# EasyEDA Pro project cubicat_pcb.eprj, board PCB_lcd
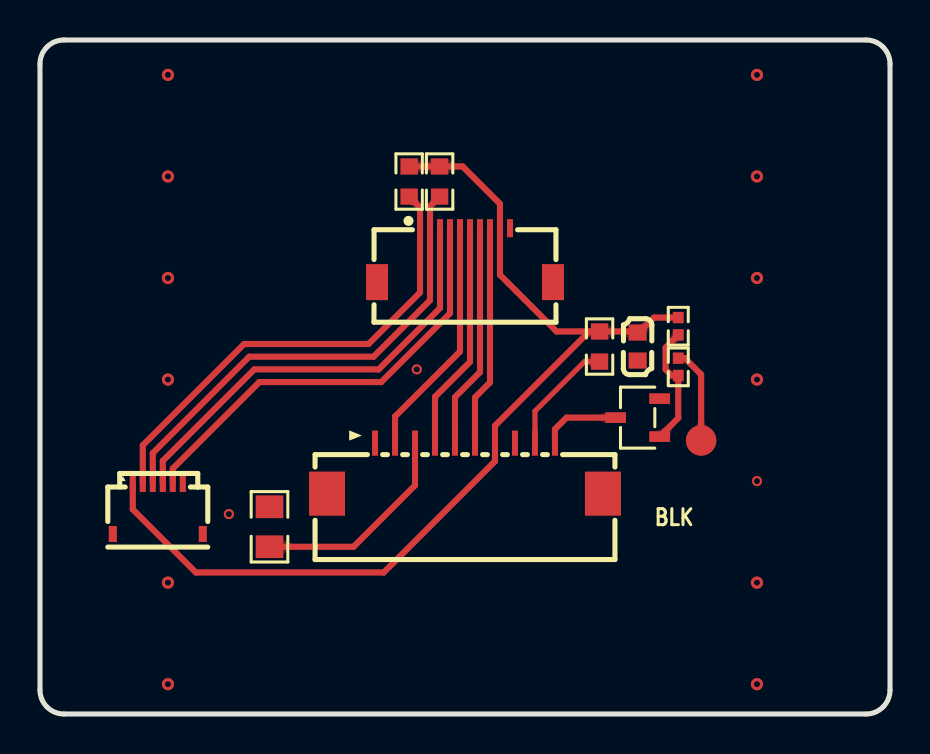
[diagram p5: board, top side]
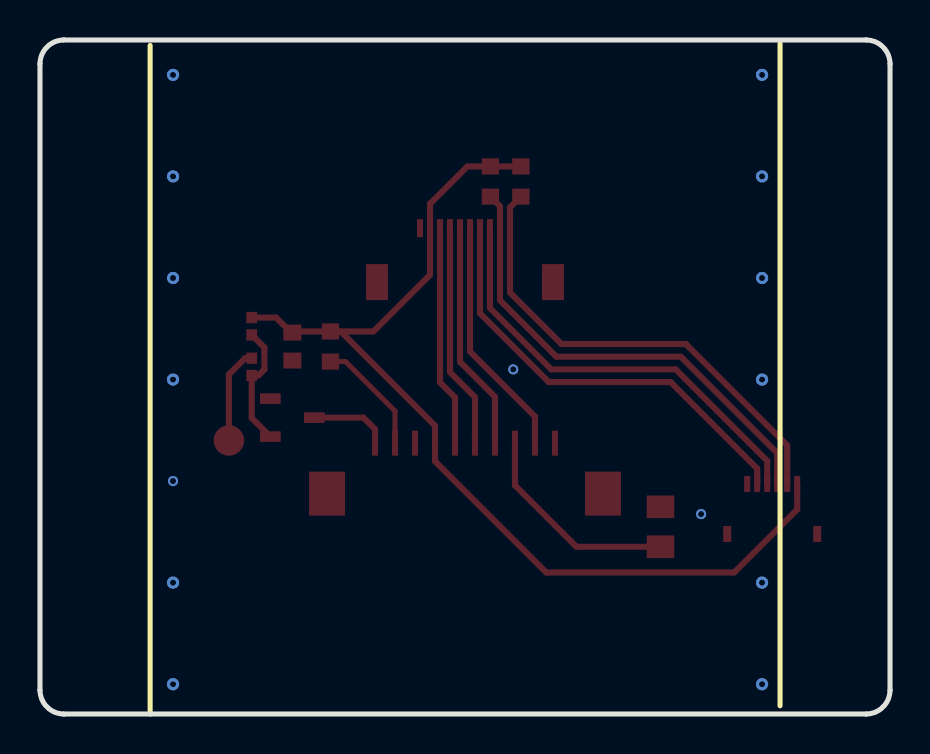
[diagram p6: board, bottom side, seen from below]

Outline 42.52 x 33.72 mm; copper layers: Top Layer, Bottom Layer. Coordinates in mm from the lower left corner of the outline.
Outline path: 0,32.52 0,1.2 arc(0.35,0.35) 1.2,0 41.32,0 arc(42.17,0.35) 42.52,1.2 42.52,32.52 arc(42.17,33.37) 41.32,33.72 1.2,33.72 arc(0.35,33.37) 0,32.52
Stack: Top Layer 0.035mm / Dielectric1 1.51mm FR4 er 4.5 / Bottom Layer 0.035mm

## Design rules (mm)
template: JLCPCB Capability(Two Layers Board)
spacing copperThickness1oz (default): track to track 0.102, other pairs 0.152 to 0.3
spacing copperThickness2oz: track to track 0.203, other pairs 0.152 to 0.3
track width copperThickness1oz (default): min 0.127, default 0.254, max 2.54
track width copperThickness2oz: min 0.203, default 0.254, max 2.54
differential pair differentialPair (default): width min 0.127, default 0.254, max 2.54; gap min 0.152, default 0.152
via viaSize (default): diameter min 0.5, default 0.61, max 10; hole min 0.3, default 0.305, max 6.3

## Placement (name value [footprint] x y rotation side)
C1  100nF  [C0603]  29.9 18.38 90 top
FPC3  FPC-05F-10PH15  [FPC-SMD_10P-P0.50_XUNPU_FPC-05F-10PH15]  21.26 22.96 0 top
FPC4  10A20L10P  [FPC-SMD_10P-P1.00_10A20L10P]  21.26 12.29 0 top
FPC6  HC-FPC-05-09-6RLTAG  [FPC-SMD_6P-P0.50_HC-FPC-05-09-6RLTAG]  5.89 10.26 180 top
NOREF  -  [Pad_e1400]  33.07 13.69 0 top
Q1  S8050 J3Y  [SOT-23-3_L3.0-W1.7-P0.95-LS2.9-BR]  29.9 14.83 0 top
R1  2Ω  [R0603]  27.99 18.38 270 top
R2  51kΩ  [R0805]  11.48 9.37 270 top
R4  10kΩ  [R0402]  31.93 19.4 270 top
R5  1kΩ  [R0402]  31.93 17.37 270 top
R6  5.1kΩ  [R0603]  19.99 26.64 90 top
R7  5.1kΩ  [R0603]  18.47 26.64 90 top

## Footprints (pads in the part's own frame, mm; a bottom-side part is the same pattern mirrored in y, then rotated)
C0603
  rect 0.8x0.9 smd: 1(-0.7,0) 2(0.7,0)
FPC-SMD_6P-P0.50_HC-FPC-05-09-6RLTAG
  rect 0.3x0.8 smd: 1(1.25,-1.25) 2(0.75,-1.25) 3(0.25,-1.25) 4(-0.25,-1.25) 5(-0.75,-1.25) 6(-1.25,-1.25)
  rect 0.4x0.8 smd: 7(-2.25,1.25) 8(2.25,1.25)
FPC-SMD_10P-P0.50_XUNPU_FPC-05F-10PH15
  rect 0.3x0.9 smd: 1(-2.25,1.35) 2(-1.75,1.35) 3(-1.25,1.35) 4(-0.75,1.35) 5(-0.25,1.35) 6(0.25,1.35) 7(0.75,1.35) 8(1.25,1.35) 9(1.75,1.35) 10(2.25,1.35)
  rect 1.1x1.8 smd: 11(4.4,-1.35) 12(-4.4,-1.35)
FPC-SMD_10P-P1.00_10A20L10P
  rect 0.3x1.25 smd: 1(-4.5,1.262) 2(-3.5,1.262) 3(-2.5,1.262) 4(-1.5,1.262) 5(-0.5,1.262) 6(0.5,1.262) 7(1.5,1.262) 8(2.5,1.262) 9(3.5,1.262) 10(4.5,1.262)
  rect 1.8x2.2 smd: 11(6.9,-1.262) 12(-6.9,-1.262)
Pad_e1400
  round 1.524 smd: 13(0,0)
R0402
  rect 0.566x0.54 smd: 1(-0.433,0) 2(0.433,0)
R0603
  rect 0.806x0.864 smd: 1(-0.753,0) 2(0.753,0)
R0805
  rect 1.133x1.377 smd: 1(-1,0) 2(1,0)
SOT-23-3_L3.0-W1.7-P0.95-LS2.9-BR
  rect 1.038x0.532 smd: 1(1.101,-0.95) 2(1.101,0.95) 3(-1.101,0)

## Nets
As in the schematic, except:
BLK: NOREF.13 R5.1

## Via types
v1: diameter 0.61, hole 0.305, Top Layer to Bottom Layer, 12 vias
v2: diameter 0.508, hole 0.305, Top Layer to Bottom Layer, 3 vias

## Routing (per net, layer and track width the routed paths; a pad name or vN(x,y) marks a point on that pad's centre or on a via; arc(x,y) is an arc through that point)
GND:
  vias: v1(6.4,31.97) v1(6.4,26.89) v1(6.4,21.81) v1(6.4,16.73) v1(6.4,6.57) v1(6.4,1.49) v1(35.86,31.97) v1(35.86,26.89) v1(35.86,21.81) v1(35.86,16.73) v1(35.86,6.57) v1(35.86,1.49) v2(9.45,10) v2(18.85,17.24) v2(35.86,11.65)
VCC_3V3: length 50.7
  Top Layer w0.305: 31.93,19.83 30.71,19.83 30.01,19.14 R1.1 27.47,19.14 ; R7.2 R6.2 21.14,27.39 23.01,25.52 FPC3.9 23.01,21.97 25.84,19.14 27.47,19.14 ; 27.47,19.14 22.76,14.42 FPC4.7 22.76,12.64 17.2,7.08 7.8,7.08 4.64,10.24 FPC6.1
BLK: length 4.8
  Top Layer w0.305: R5.1 32.26,17.8 33.07,16.99 NOREF.13
DC: length 12.1
  Top Layer w0.305: FPC4.2 17.76,14.88 21.01,18.13 FPC3.5
RST: length 11.1
  Top Layer w0.305: FPC4.6 21.76,15.84 22.51,16.59 FPC3.8
SCL: length 11.5
  Top Layer w0.305: FPC4.4 19.76,15.87 21.51,17.62 FPC3.6
SDA: length 11.3
  Top Layer w0.305: FPC4.5 20.76,15.85 22.01,17.1 FPC3.7
TP_INT: length 22.2
  Top Layer w0.305: FPC3.3 20.01,20.31 16.94,17.24 10.72,17.24 6.14,12.67 FPC6.4
TP_RST: length 22.1
  Top Layer w0.305: FPC3.4 20.51,20.05 17.07,16.61 10.97,16.61 6.64,12.28 FPC6.5
TP_SCL: length 24
  Top Layer w0.305: FPC6.2 5.14,13.44 10.21,18.51 16.43,18.51 19.01,21.09 FPC3.1 19.01,25.34 R7.1
TP_SDA: length 24
  Top Layer w0.305: FPC6.3 5.64,13.05 10.47,17.88 16.69,17.88 19.51,20.7 FPC3.2 19.51,25.41 R6.1
$1N718: length 10.7
  Top Layer w0.305: R2.2 15.69,8.37 18.76,11.44 FPC4.3
$1N906: length 5.9
  Top Layer w0.254: FPC4.9 24.76,15.15 27.24,17.63 R1.2
$1N2550: length 4
  Top Layer w0.305: Q1.3 26.34,14.83 25.76,14.25 FPC4.10
$1N2571: length 6.2
  Top Layer w0.305: R4.2 31.29,18.33 31.29,17.24 31.6,16.94 31.93,16.94 31.93,14.81 Q1.1

## Copper pours and planes (outline as drawn; the poured copper is in the pictures)
GND on Top Layer: -5.54,36.04 44.5,36.04 44.5,-4.73 -5.54,-4.73
GND on Bottom Layer: -5.66,35.91 45.14,35.91 45.14,-5.24 -5.66,-5.24

Small or netless copper shapes (teardrops, artwork), in the pictures only: 19 on Top Layer

## Text on the board
Top Silkscreen Layer: BLK
